# EasyEDA Pro project Archive.eprj, board GPR3.0
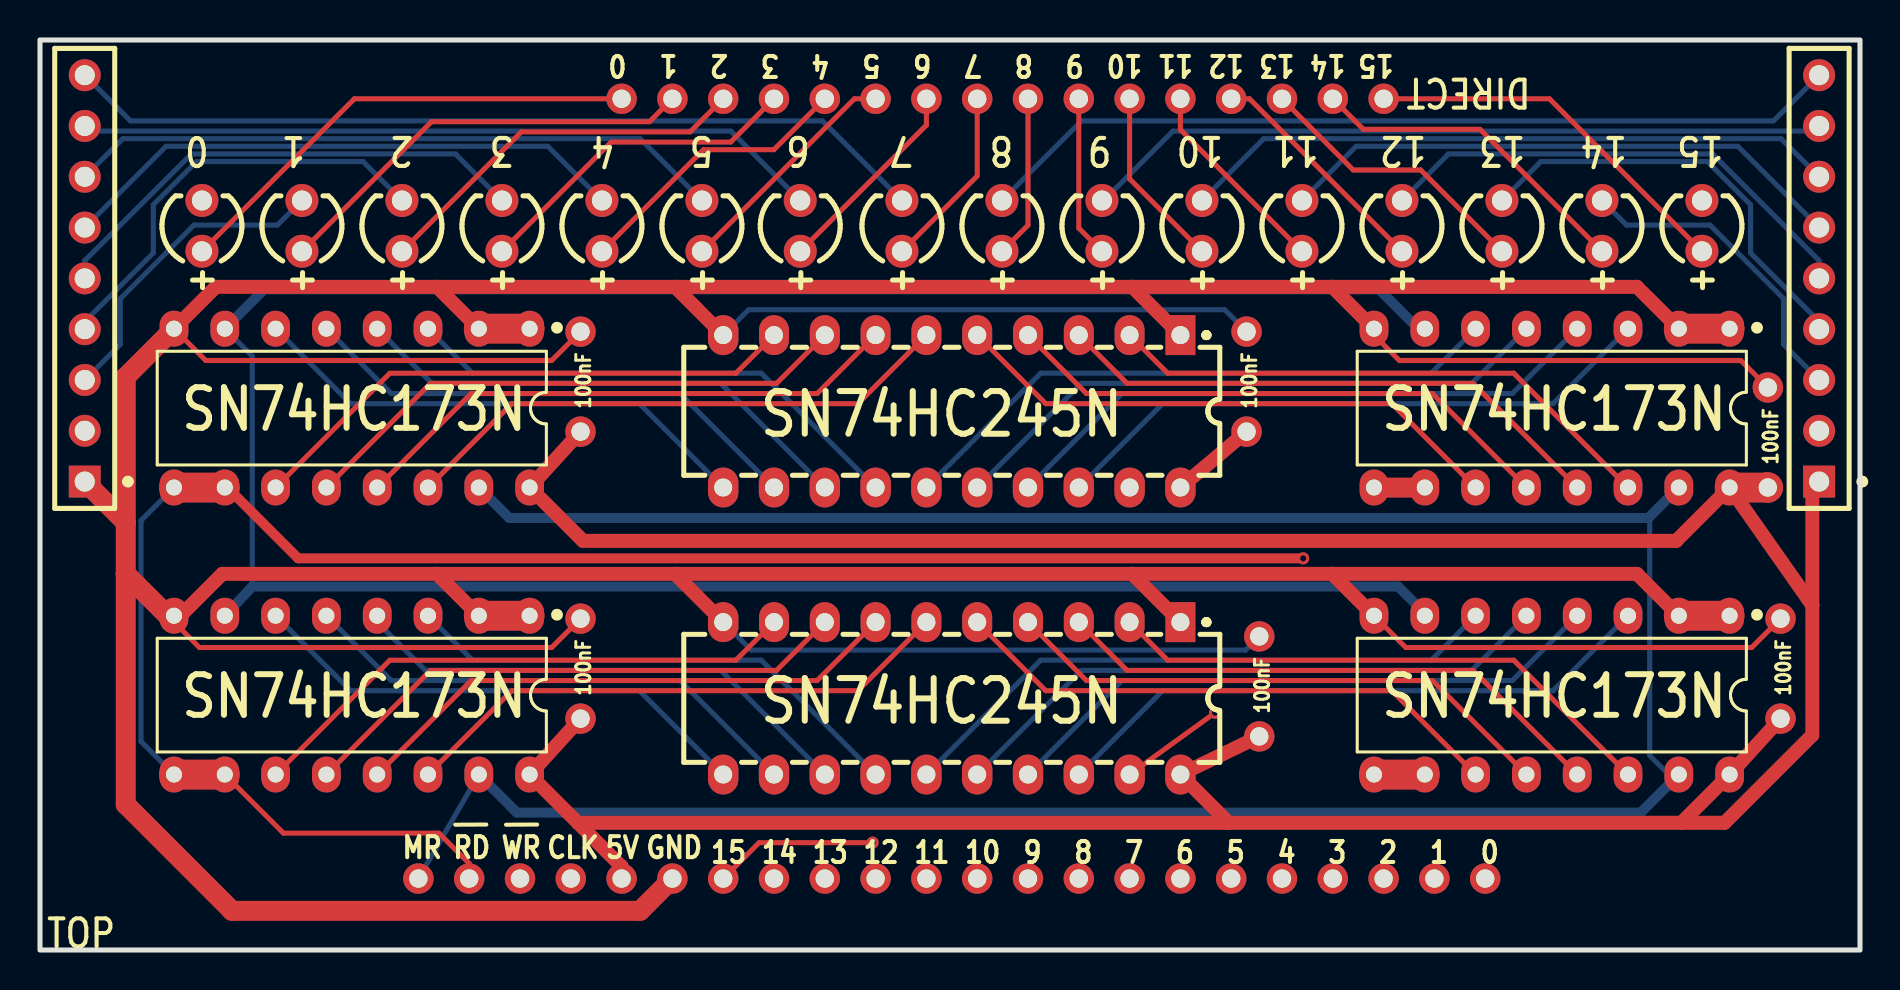
[diagram p4: board, top side]
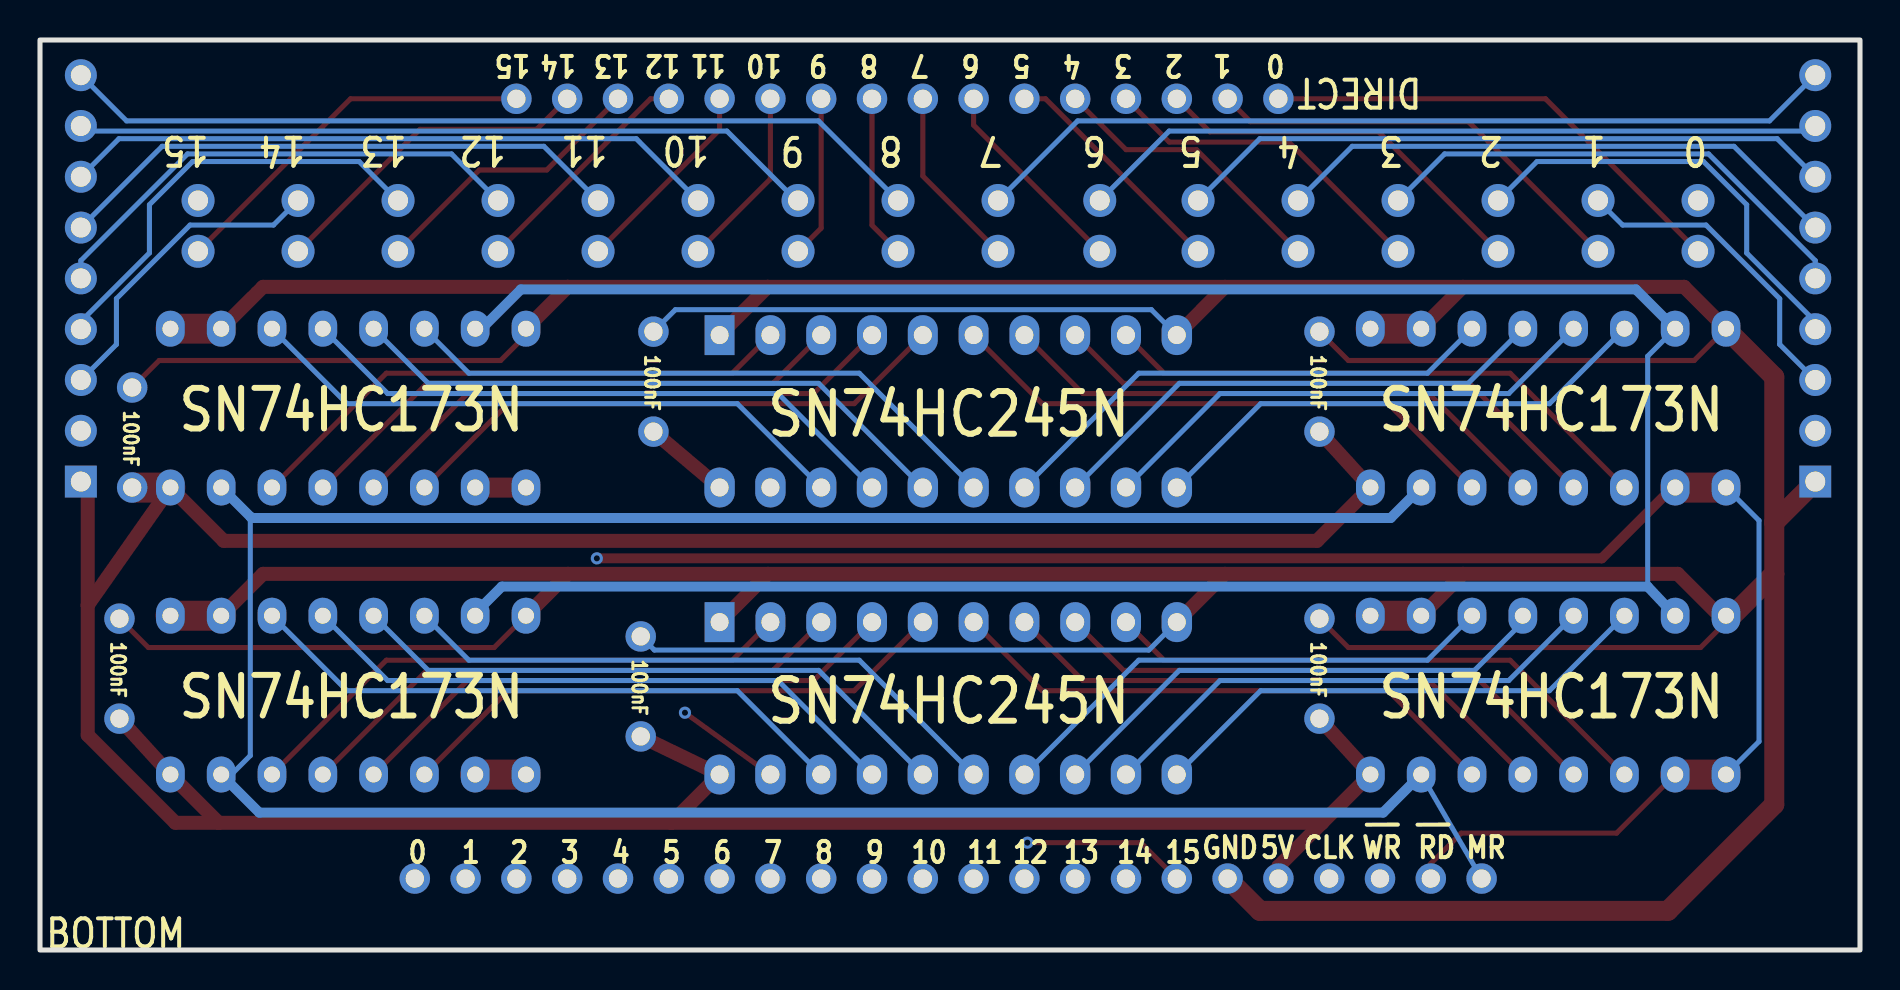
[diagram p5: board, bottom side, seen from below]

Outline 91 x 45.5 mm; copper layers: Top Layer, Inner1, Inner2, Bottom Layer. Coordinates in mm from the lower left corner of the outline.
Outline path: rectangle 0,45.5 91,0
Stack: Top Layer 0.035mm Outer layer thickness 1oz / Dielectric1 0.2104mm 7628 RC49% 8.6mil / Inner1 0.0152mm Inner layer thickness / Dielectric2 1.065mm 1.1mm H/HOZ Copper / Inner2 0.0152mm Inner layer thickness / Dielectric3 0.2104mm 7628 RC49% 8.6mil / Bottom Layer 0.035mm Outer layer thickness 1oz

## Design rules (mm)
template: JLCPCB Capability(Two Layers Board)
spacing copperThickness1oz (default): track to track 0.102, other pairs 0.152 to 0.3
spacing copperThickness2oz: track to track 0.203, other pairs 0.152 to 0.3
track width copperThickness1oz (default): min 0.127, default 0.254, max 2.54
track width copperThickness2oz: min 0.203, default 0.254, max 2.54
differential pair differentialPair (default): width min 0.127, default 0.254, max 2.54; gap min 0.152, default 0.152
via viaSize (default): diameter min 0.5, default 0.61, max 10; hole min 0.3, default 0.305, max 6.3

## Placement (name value [footprint] x y rotation side)
NOREF  -  [Pad_e157]  62.1 3.57 180 top
NOREF#2  -  [Pad_e428]  60.33 30.92 0 top
NOREF#3  -  [Pad_e172]  18.92 3.57 270 top
NOREF#4  -  [Pad_e171]  59.56 3.57 270 top
NOREF#5  -  [Pad_e177]  29.08 3.57 270 top
NOREF#6  -  [Pad_e426]  60.96 15.68 0 top
NOREF#7  -  [Pad_e711]  54.48 42.56 270 top
NOREF#8  -  [Pad_e156]  64.64 3.57 180 top
NOREF#9  -  [Pad_e447]  27.03 30.92 0 top
NOREF#10  -  [Pad_e154]  69.72 3.57 180 top
NOREF#11  -  [Pad_e769]  67.18 42.56 270 top
NOREF#12  -  [Pad_e163]  46.86 3.57 270 top
NOREF#13  -  [Pad_e707]  64.64 42.56 270 top
NOREF#14  -  [Pad_e449]  27.03 25.92 0 top
NOREF#15  -  [Pad_e158]  57.02 3.57 270 top
NOREF#16  -  [Pad_e719]  34.16 42.56 270 top
NOREF#17  -  [Pad_e173]  39.24 3.57 270 top
NOREF#18  -  [Pad_e164]  44.32 3.57 270 top
NOREF#19  -  [Pad_e718]  36.7 42.56 270 top
NOREF#20  -  [Pad_e178]  26.54 3.57 270 top
NOREF#21  -  [Pad_e427]  60.33 25.92 0 top
NOREF#22  -  [Pad_e709]  59.56 42.56 270 top
NOREF#23  -  [Pad_e708]  62.1 42.56 270 top
NOREF#24  -  [Pad_e706]  29.08 42.56 270 top
NOREF#25  -  [Pad_e712]  51.94 42.56 270 top
NOREF#26  -  [Pad_e161]  51.94 3.57 270 top
NOREF#27  -  [Pad_e420]  87.03 11.57 0 top
NOREF#28  -  [Pad_e176]  31.62 3.57 270 top
NOREF#29  -  [Pad_e180]  21.46 3.57 270 top
NOREF#30  -  [Pad_e715]  44.32 42.56 270 top
NOREF#31  -  [Pad_e448]  27.03 11.57 0 top
NOREF#32  -  [Pad_e717]  39.24 42.56 270 top
NOREF#33  -  [Pad_e716]  41.78 42.56 270 top
NOREF#34  -  [Pad_e421]  87.03 16.57 0 top
NOREF#35  -  [Pad_e179]  24 3.57 270 top
NOREF#36  -  [Pad_e422]  86.39 28.12 0 top
NOREF#37  -  [Pad_e162]  49.4 3.57 270 top
NOREF#38  -  [Pad_e155]  67.18 3.57 180 top
NOREF#39  -  [Pad_e174]  36.7 3.57 270 top
NOREF#40  -  [Pad_e713]  49.4 42.56 270 top
NOREF#41  -  [Pad_e714]  46.86 42.56 270 top
NOREF#42  -  [Pad_e720]  31.62 42.56 270 top
NOREF#43  -  [Pad_e159]  54.48 3.57 270 top
NOREF#44  -  [Pad_e170]  41.78 3.57 270 top
NOREF#45  -  [Pad_e175]  34.16 3.57 270 top
NOREF#46  -  [Pad_e710]  57.02 42.56 270 top
NOREF#47  -  [Pad_e429]  60.96 10.68 0 top
NOREF#48  -  [Pad_e152]  72.26 3.57 180 top
NOREF#49  -  [Pad_e446]  27.03 16.57 0 top
NOREF#50  -  [Pad_e423]  86.39 23.12 0 top
RN1  -  [RES-ARRAY-TH_9P-P2.54-D1.0]  2.24 33.58 90 top
RN1#2  -  [RES-ARRAY-TH_9P-P2.54-D1.0]  88.96 33.58 90 top
U14  -  [LED-TH_BD4.0-P2.54-FD_RED]  8.1 36.21 90 top
U14#2  -  [LED-TH_BD4.0-P2.54-FD_RED]  13.1 36.21 90 top
U14#3  -  [LED-TH_BD4.0-P2.54-FD_RED]  18.1 36.21 90 top
U14#4  -  [LED-TH_BD4.0-P2.54-FD_RED]  23.1 36.21 90 top
U14#5  -  [LED-TH_BD4.0-P2.54-FD_RED]  28.1 36.21 90 top
U14#6  -  [LED-TH_BD4.0-P2.54-FD_RED]  33.1 36.21 90 top
U14#7  -  [LED-TH_BD4.0-P2.54-FD_RED]  38.01 36.21 90 top
U14#8  -  [LED-TH_BD4.0-P2.54-FD_RED]  43.1 36.21 90 top
U14#9  -  [LED-TH_BD4.0-P2.54-FD_RED]  48.1 36.21 90 top
U14#10  -  [LED-TH_BD4.0-P2.54-FD_RED]  53.1 36.21 90 top
U14#11  -  [LED-TH_BD4.0-P2.54-FD_RED]  58.1 36.21 90 top
U14#12  -  [LED-TH_BD4.0-P2.54-FD_RED]  63.1 36.21 90 top
U14#13  -  [LED-TH_BD4.0-P2.54-FD_RED]  68.1 36.21 90 top
U14#14  -  [LED-TH_BD4.0-P2.54-FD_RED]  73.1 36.21 90 top
U14#15  -  [LED-TH_BD4.0-P2.54-FD_RED]  78.1 36.21 90 top
U14#16  -  [LED-TH_BD4.0-P2.54-FD_RED]  83.1 36.21 90 top
U15  -  [PDIP-16_L19.3-W6.4-P2.54-LS7.94-BL]  75.59 27.09 180 top
U15#2  -  [PDIP-16_L19.3-W6.4-P2.54-LS7.94-BL]  15.59 27.09 180 top
U15#3  -  [PDIP-16_L19.3-W6.4-P2.54-LS7.94-BL]  15.59 12.74 180 top
U15#4  -  [PDIP-16_L19.3-W6.4-P2.54-LS7.94-BL]  75.59 12.74 180 top
U16  -  [DIP-20_L26.8-W6.4-P2.54-LS7.6-BL]  45.59 26.94 180 top
U16#2  -  [DIP-20_L26.8-W6.4-P2.54-LS7.6-BL]  45.59 12.58 180 top

## Footprints (pads in the part's own frame, mm; a bottom-side part is the same pattern mirrored in y, then rotated)
DIP-20_L26.8-W6.4-P2.54-LS7.6-BL
  rect 1.5x2 hole 0.9: 1(-11.43,-3.81)
  oval 1.5x2 hole 0.9: 2(-8.89,-3.81) 3(-6.35,-3.81) 4(-3.81,-3.81) 5(-1.27,-3.81) 6(1.27,-3.81) 7(3.81,-3.81) 8(6.35,-3.81) 9(8.89,-3.81)
  oval 1.524x2 hole 0.9: 10(11.43,-3.81) 11(11.43,3.81) 12(8.89,3.81) 13(6.35,3.81) 14(3.81,3.81) 15(1.27,3.81) 16(-1.27,3.81) 17(-3.81,3.81) 18(-6.35,3.81) 19(-8.89,3.81) 20(-11.43,3.81)
LED-TH_BD4.0-P2.54-FD_RED
  round 1.651 hole 1: 1(-1.27,0) 2(1.27,0)
Pad_e152
  round 1.524 hole 0.914: 22(0,0)
Pad_e154
  round 1.524 hole 0.914: 21(0,0)
Pad_e155
  round 1.524 hole 0.914: 20(0,0)
Pad_e156
  round 1.524 hole 0.914: 19(0,0)
Pad_e157
  round 1.524 hole 0.914: 18(0,0)
Pad_e158
  round 1.524 hole 0.914: 16(0,0)
Pad_e159
  round 1.524 hole 0.914: 15(0,0)
Pad_e161
  round 1.524 hole 0.914: 14(0,0)
Pad_e162
  round 1.524 hole 0.914: 13(0,0)
Pad_e163
  round 1.524 hole 0.914: 12(0,0)
Pad_e164
  round 1.524 hole 0.914: 11(0,0)
Pad_e170
  round 1.524 hole 0.914: 10(0,0)
Pad_e171
  round 1.524 hole 0.914: 17(0,0)
Pad_e172
  round 1.524 hole 0.914: 1(0,0)
Pad_e173
  round 1.524 hole 0.914: 9(0,0)
Pad_e174
  round 1.524 hole 0.914: 8(0,0)
Pad_e175
  round 1.524 hole 0.914: 7(0,0)
Pad_e176
  round 1.524 hole 0.914: 6(0,0)
Pad_e177
  round 1.524 hole 0.914: 5(0,0)
Pad_e178
  round 1.524 hole 0.914: 4(0,0)
Pad_e179
  round 1.524 hole 0.914: 3(0,0)
Pad_e180
  round 1.524 hole 0.914: 2(0,0)
Pad_e420
  round 1.524 hole 0.914: 1(0,0)
Pad_e421
  round 1.524 hole 0.914: 2(0,0)
Pad_e422
  round 1.524 hole 0.914: 2(0,0)
Pad_e423
  round 1.524 hole 0.914: 1(0,0)
Pad_e426
  round 1.524 hole 0.914: 2(0,0)
Pad_e427
  round 1.524 hole 0.914: 1(0,0)
Pad_e428
  round 1.524 hole 0.914: 2(0,0)
Pad_e429
  round 1.524 hole 0.914: 1(0,0)
Pad_e446
  round 1.524 hole 0.914: 2(0,0)
Pad_e447
  round 1.524 hole 0.914: 2(0,0)
Pad_e448
  round 1.524 hole 0.914: 1(0,0)
Pad_e449
  round 1.524 hole 0.914: 1(0,0)
Pad_e706
  round 1.524 hole 0.914: 1(0,0)
Pad_e707
  round 1.524 hole 0.914: 15(0,0)
Pad_e708
  round 1.524 hole 0.914: 14(0,0)
Pad_e709
  round 1.524 hole 0.914: 13(0,0)
Pad_e710
  round 1.524 hole 0.914: 12(0,0)
Pad_e711
  round 1.524 hole 0.914: 11(0,0)
Pad_e712
  round 1.524 hole 0.914: 10(0,0)
Pad_e713
  round 1.524 hole 0.914: 9(0,0)
Pad_e714
  round 1.524 hole 0.914: 8(0,0)
Pad_e715
  round 1.524 hole 0.914: 7(0,0)
Pad_e716
  round 1.524 hole 0.914: 6(0,0)
Pad_e717
  round 1.524 hole 0.914: 5(0,0)
Pad_e718
  round 1.524 hole 0.914: 4(0,0)
Pad_e719
  round 1.524 hole 0.914: 3(0,0)
Pad_e720
  round 1.524 hole 0.914: 2(0,0)
Pad_e769
  round 1.524 hole 0.914: 16(0,0)
PDIP-16_L19.3-W6.4-P2.54-LS7.94-BL
  oval 1.44x1.8 hole 0.8: 1(-8.89,-3.97) 2(-6.35,-3.97) 3(-3.81,-3.97) 4(-1.27,-3.97) 5(1.27,-3.97) 6(3.81,-3.97) 7(6.35,-3.97) 8(8.89,-3.97) 9(8.89,3.97) 10(6.35,3.97) 11(3.81,3.97) 12(1.27,3.97) 13(-1.27,3.97) 14(-3.81,3.97) 15(-6.35,3.97) 16(-8.89,3.97)
RES-ARRAY-TH_9P-P2.54-D1.0
  rect 1.6x1.6 hole 1: 1(-10.16,0)
  round 1.6 hole 1: 2(-7.62,0) 3(-5.08,0) 4(-2.54,0) 5(0,0) 6(2.54,0) 7(5.08,0) 8(7.62,0) 9(10.16,0)

## Nets

Pads without a net: NOREF 18; NOREF#2 2; NOREF#3 1; NOREF#4 17; NOREF#5 5; NOREF#6 2; NOREF#7 11; NOREF#8 19; NOREF#9 2; NOREF#10 21; NOREF#11 16; NOREF#12 12; NOREF#13 15; NOREF#14 1; NOREF#15 16; NOREF#16 3; NOREF#17 9; NOREF#18 11; NOREF#19 4; NOREF#20 4; NOREF#21 1; NOREF#22 13; NOREF#23 14; NOREF#24 1; NOREF#25 10; NOREF#26 14; NOREF#27 1; NOREF#28 6; NOREF#29 2; NOREF#30 7; NOREF#31 1; NOREF#32 5; NOREF#33 6; NOREF#34 2; NOREF#35 3; NOREF#36 2; NOREF#37 13; NOREF#38 20; NOREF#39 8; NOREF#40 9; NOREF#41 8; NOREF#42 2; NOREF#43 15; NOREF#44 10; NOREF#45 7; NOREF#46 12; NOREF#47 1; NOREF#48 22; NOREF#49 2; NOREF#50 1; RN1 1 2 3 4 5 6 7 8 9; RN1#2 1 2 3 4 5 6 7 8 9; U14 1 2; U14#2 1 2; U14#3 1 2; U14#4 1 2; U14#5 1 2; U14#6 1 2; U14#7 1 2; U14#8 1 2; U14#9 1 2; U14#10 1 2; U14#11 1 2; U14#12 1 2; U14#13 1 2; U14#14 1 2; U14#15 1 2; U14#16 1 2; U15 1 2 3 4 5 6 7 8 9 10 11 12 13 14 15 16; U15#2 1 2 3 4 5 6 7 8 9 10 11 12 13 14 15 16; U15#3 1 2 3 4 5 6 7 8 9 10 11 12 13 14 15 16; U15#4 1 2 3 4 5 6 7 8 9 10 11 12 13 14 15 16; U16 1 2 3 4 5 6 7 8 9 10 11 12 13 14 15 16 17 18 19 20; U16#2 1 2 3 4 5 6 7 8 9 10 11 12 13 14 15 16 17 18 19 20

## Via types
v1: diameter 0.61, hole 0.305, Top Layer to Bottom Layer, 3 vias

## Routing (per net, layer and track width the routed paths; a pad name or vN(x,y) marks a point on that pad's centre or on a via; arc(x,y) is an arc through that point)
(no net): length 3816.4
  Top Layer w0.254: NOREF#9.2 25.58,29.47 8.29,29.47 U15#2.8 ; NOREF#32.5 36.69,40.02 33.18,40.02 U14#5.1 ; U14#2.1 19.57,41.41 30.47,41.41 NOREF#42.2 ; NOREF#22.13 60.47,42.56 U14#13.1 ; U16#2.4 52.32,13.47 69.62,13.47 U15#4.12 ; U15#3.10 12.17,5.84 19.94,5.84 21.46,4.33 NOREF#29.2 ; NOREF#46.12 57.02,41.01 U14#12.1 ; U16#2.19 v1(58.75,11.86) ; NOREF#34.2 85.58,15.12 68.29,15.12 U15#4.8 ; U16#2.8 36.83,13.98 19.53,13.98 U15#3.12 ; v1(41.63,5.37) 35.96,5.37 NOREF#45.7 ; U14#10.1 51.94,36.09 NOREF#25.10 ; NOREF#40.9 49.4,36.24 U14#9.1 ; U14.1 15.72,42.56 NOREF#24.1 ; U16#2.6 40.89,12.97 23.59,12.97 U15#3.14 ; NOREF#16.3 32.5,40.91 24.07,40.91 U14#3.1 ; NOREF#19.4 34.54,40.4 28.56,40.4 U14#4.1 ; U16.6 40.89,27.32 23.59,27.32 U15#2.14 ; U16#2.9 34.79,14.49 17.5,14.49 U15#3.11 ; U15#2.11 17.5,28.84 34.79,28.84 U16.9 ; U15.11 67.59,27.32 50.29,27.32 U16.5 ; 66.7,30.75 67.97,29.47 85.04,29.47 NOREF#36.2 ; NOREF#33.6 40.72,42.56 U14#6.1 ; U16.4 52.32,27.82 69.62,27.82 U15.12 ; U15#4.13 71.65,13.98 54.35,13.98 U16#2.3 ; U16.3 54.35,28.33 71.65,28.33 U15.13 ; NOREF#30.7 44.32,41.24 U14#7.1 ; NOREF#49.2 25.58,15.12 7.97,15.12 6.7,16.39 ; NOREF#11.16 75.47,42.56 U14#16.1 ; U15#3.13 21.56,13.47 38.86,13.47 U16#2.7 ; U15#2.13 21.56,27.82 38.86,27.82 U16.7 ; NOREF#23.14 65.66,39 69.03,39 U14#14.1 ; U16#2.5 50.29,12.97 67.59,12.97 U15#4.11 ; U15#2.12 19.53,28.33 36.83,28.33 U16.8 ; U15.14 73.69,28.84 56.38,28.84 U16.2 ; U14#11.1 54.48,38.55 NOREF#7.11 ; NOREF#41.8 46.86,38.7 U14#8.1 ; U14#15.1 72,41.03 66.17,41.03 NOREF#13.15 ; U16#2.2 56.38,14.49 73.69,14.49 U15#4.14
  Top Layer w0.5: v1(63.16,19.58) 12.91,19.58 9.37,23.12
  Top Layer w0.7: 54.61,18.81 U16#2.1 ; 54.61,18.81 31.75,18.81 ; 54.61,18.81 64.61,18.81 ; 64.61,18.81 U15#4.8 ; 64.61,18.81 79.85,18.81 U15#4.2 ; 64.61,33.16 54.61,33.16 ; 64.61,33.16 79.85,33.16 U15.2 ; 64.61,33.16 U15.8 ; 54.61,33.16 U16.1 ; 54.61,33.16 31.75,33.16 ; RN1#2.1 88.62,23.08 88.62,17.24 ; 31.75,18.81 U16#2.10 ; 31.75,18.81 19.85,18.81 ; 82.07,6.36 U15#4.16 NOREF#27.1 ; 82.07,6.36 59.43,6.36 ; 82.07,6.36 84.23,6.36 88.62,10.75 88.62,17.24 ; 88.62,17.24 U15.16 81.81,20.46 27.15,20.46 U15#2.16 NOREF#14.1 ; NOREF#31.1 U15#3.16 26.89,6.36 ; U16.20 NOREF#21.1 ; 31.75,33.16 U16.10 ; 31.75,33.16 19.85,33.16 ; NOREF#47.1 U16#2.20 59.43,6.36 ; 19.85,18.81 9.11,18.81 6.7,16.39 ; 19.85,18.81 U15#3.2 ; 26.89,6.36 29.08,4.17 NOREF#5.5 ; 26.89,6.36 59.43,6.36 ; U15#2.8 8.79,33.16 19.85,33.16 ; 66.7,30.75 66.54,30.91 ; 19.85,33.16 U15#2.2
  Top Layer w1: 4.29,21.37 RN1.1 ; 4.29,21.37 4.29,28.65 U15#2.8 ; 4.29,21.37 4.29,18.81 ; 4.29,18.81 6.7,16.39 ; 4.29,18.81 4.29,7.27 9.6,1.96 30.01,1.96 NOREF#28.6 ; U15.10 U15.9
  Top Layer w1.5: U15.1 U15.2 ; U15#3.1 U15#3.2 ; U15.16 NOREF#50.1 ; U15#3.10 U15#3.9 ; U15#2.10 U15#2.9 ; U15#2.1 U15#2.2 ; U15#4.10 U15#4.9 ; U15#4.2 U15#4.1
  Inner1 w0.254: U16.7 35.51,24.48 35.51,22.15 28.15,14.78 28.15,2.34 29.03,1.45 44.74,1.45 NOREF#12.12 ; U15.6 U14#13.1 ; NOREF#44.10 40.42,2.21 33.86,2.21 32.97,3.1 32.97,12.5 35.38,14.91 35.38,17.07 40.59,22.28 40.59,24.48 U16.5 ; U15#4.10 70.58,10.11 70.58,21.78 U15.10 ; NOREF#15.16 59.69,6.24 59.69,16.51 58.49,17.71 53.25,17.71 U16#2.3 ; U16.4 43.13,24.48 43.13,22.28 37.92,17.07 37.92,13.77 35.38,11.23 35.38,3.36 36.15,2.59 38.26,2.59 NOREF#17.9 ; U16#2.4 51.22,18.21 60.27,18.21 62.23,16.26 62.23,6.24 NOREF#4.17 ; U16#2.5 49.19,18.72 60.4,18.72 63.37,15.75 63.37,4.85 NOREF.18 ; U15.3 U14#16.1 ; U15#3.4 18.1,17.95 U14#3.1 ; U16.6 37.92,24.35 37.92,22.15 30.3,14.53 30.3,3.1 31.57,1.83 42.58,1.83 NOREF#18.11 ; v1(63.16,19.58) U15.9 ; U16#2.2 55.7,15.17 55.7,4.8 NOREF#43.15 ; U15.4 U14#15.1 ; U14#4.1 23.1,20.41 U15#3.3 ; U15#3.6 8.1,20.4 U14.1 ; U14#2.1 13.1,17.94 U15#3.5 ; U16.2 48.11,24.37 48.11,22 43.03,16.92 43.03,6.77 v1(41.63,5.37) ; U15#2.3 19.4,33.71 21.81,36.12 50.09,36.12 53.06,33.16 61.32,33.16 U14#12.1 ; U14#10.1 49.37,38.66 17.48,38.66 14.32,35.5 U15#2.5 ; NOREF#39.8 40.46,7.34 40.46,17.07 45.54,22.15 45.54,24.35 U16.3 ; U16.8 25.48,16.98 25.48,2.59 27,1.07 46.9,1.07 NOREF#37.13 ; U15.5 U14#14.1 ; U16.9 22.94,16.98 22.94,2.59 24.84,0.69 49.06,0.69 NOREF#26.14
  Inner2 w0.254: U16#2.6 46.94,13.77 54.44,13.77 NOREF#8.19 ; 80.47,13.52 78.82,11.86 v1(58.75,11.86) ; 80.47,13.52 80.47,17.58 77.42,20.63 56.98,20.63 U16.19 ; 80.47,13.52 80.47,7.93 73.87,1.32 26.25,1.32 NOREF#35.3 ; U15#4.4 74.77,18.81 40.74,18.81 37.94,21.6 37.94,34.87 U14#7.1 ; U15#2.4 21.79,35.99 44.53,35.99 47.36,33.16 56.32,33.16 U14#11.1 ; U14#9.1 46.66,36.38 17.09,36.38 U15#2.6 ; U14#8.1 43.1,22.16 45.05,20.2 75.91,20.2 U15#4.3 ; NOREF#38.20 66.07,2.47 43.74,2.47 43.02,3.19 43.02,15.15 U16#2.7 ; NOREF#10.21 68.23,2.08 41.58,2.08 40.48,3.19 40.48,15.15 U16#2.8 ; NOREF#48.22 70.39,1.7 39.55,1.7 37.94,3.31 37.94,15.15 U16#2.9 ; RN1.2 4.27,27.99 4.27,33.65 U14.2 ; U14#6.1 33.1,20.35 35.02,18.43 72.61,18.43 U15#4.5 ; U15#4.6 70.45,18.05 33.12,18.05 28.04,23.12 28.04,34.88 U14#5.1 ; RN1#2.2 87.45,25.96 85.55,27.87 85.55,35.02 U14#16.2
  Inner2 w0.7: U15#3.7 13.25,12.7 23.24,12.7 26.54,9.4 NOREF#20.4
  Bottom Layer w0.254: U16#2.15 50.03,14.49 69.56,14.49 U15#4.6 ; RN1.5 2.24,34.47 7.57,39.8 20.77,39.8 U14#4.2 ; U15#3.6 15.53,12.97 29.97,12.97 U16#2.11 ; U16.18 56.13,27.32 75.65,27.32 U15.3 ; U15#4.3 75.65,12.97 56.13,12.97 U16#2.18 ; U15#4.15 81.43,8.77 80.49,9.72 80.49,21.67 ; 10.61,18.17 10.61,29.69 U15#2.7 ; U16.17 54.1,27.82 73.62,27.82 U15.4 ; RN1.3 4.02,30.28 4.02,32.56 7.7,36.25 11.87,36.25 U14#2.2 ; U16#2.16 52.07,13.98 71.59,13.98 U15#4.5 ; 88.96,36.12 84.89,40.19 65.81,40.19 U14#12.2 ; U14#3.2 16.15,39.42 7.83,39.42 5.67,37.26 5.67,34.85 2.24,31.42 RN1.4 ; RN1#2.4 88.96,31.42 85.53,34.85 85.53,37.26 83.37,39.42 75.04,39.42 U14#14.2 ; U14#7.2 34.54,40.95 2.49,40.95 2.24,41.2 ; U15#3.5 17.56,13.47 32,13.47 U16#2.12 ; 2.24,36.12 6.3,40.19 25.39,40.19 U14#5.2 ; RN1#2.3 87.18,30.28 87.18,32.56 83.5,36.25 79.32,36.25 U14#15.2 ; U14#13.2 70.43,39.8 83.62,39.8 88.96,34.47 RN1#2.5 ; U14#8.2 39.12,41.45 4.52,41.45 RN1.9 ; U16#2.13 34.03,13.98 19.27,13.98 16.86,16.39 ; U15#2.9 5.05,21.47 5.05,10.42 U15#3.9 ; U15#2.4 19.59,28.33 34.03,28.33 U16.13 ; U15#4.4 73.62,13.47 54.1,13.47 U16#2.17 ; U15#2.5 17.56,27.82 32,27.82 U16.12 ; U15#2.3 21.62,28.84 36.06,28.84 U16.14 ; U16.11 29.97,27.32 15.53,27.32 U15#2.6 ; U14#9.2 52.08,41.45 86.67,41.45 RN1#2.9 ; U16#2.14 36.06,14.49 21.62,14.49 U15#3.3 ; RN1.7 4.14,40.57 30.01,40.57 U14#6.2 ; NOREF#6.2 60.28,15 35.56,15 U16#2.10 ; RN1#2.7 87.05,40.57 61.19,40.57 U14#11.2 ; 88.96,41.2 88.7,40.95 56.65,40.95 53.18,37.48 ; U16.15 50.03,28.84 69.56,28.84 U15.6 ; U16.16 52.07,28.33 71.59,28.33 U15.5 ; NOREF#3.1 U15#3.15 ; U16.10 35.43,32.02 59.23,32.02 NOREF#2.2
  Bottom Layer w0.5: U15#2.15 23.46,21.6 80.42,21.6 U15.15 ; U15#3.15 23.84,6.87 80.03,6.87 U15#4.15 ; U15.7 69.62,31.4 69.24,30.75 66.95,33.03 11.21,33.03 U15#2.7 ; U15#3.7 10.61,18.17 67.91,18.17 69.24,16.84 U15#4.7

## Text on the board
Bottom Silkscreen Layer: 100nF | / | MR | RD | WR | CLK | 5V | GND | 0 | 1 | 2 | 3 | 4 | 5 | 6 | 7 | 8 | 9 | 10 | 11 | 12 | 13 | 14 | 15 | BOTTOM | DIRECT | SN74HC173N | SN74HC245N
Top Silkscreen Layer: 100nF | MR | RD | WR | CLK | 5V | GND | / | 0 | 1 | 2 | 3 | 4 | 5 | 6 | 7 | 8 | 9 | 10 | 11 | 12 | 13 | 14 | 15 | TOP | DIRECT | SN74HC173N | SN74HC245N
